# EAGLE schematic Resistor_Resistor (EAGLE 8.3.0), part 6 of 43 (continued)
## Parts (continued)
R8053  10K  RESISTOR_0201  [0201]
R8054  10K  RESISTOR_0201  [0201]
R8055  10K  RESISTOR_0201  [0201]
R8056  10K  RESISTOR_0201  [0201]
R8057  10K  RESISTOR_0201  [0201]
R8058  10K  RESISTOR_0201  [0201]
R8059  10K  RESISTOR_0201  [0201]
R8060  10K  RESISTOR_0201  [0201]
R8061  10K  RESISTOR_0201  [0201]
R8062  10K  RESISTOR_0201  [0201]
R8063  10K  RESISTOR_0201  [0201]
R8064  10K  RESISTOR_0201  [0201]
R8065  10K  RESISTOR_0201  [0201]
R8066  10K  RESISTOR_0201  [0201]
R8067  10K  RESISTOR_0201  [0201]
R8068  10K  RESISTOR_0201  [0201]
R8069  10K  RESISTOR_0201  [0201]
R8070  10K  RESISTOR_0201  [0201]
R8071  10K  RESISTOR_0201  [0201]
R8072  10K  RESISTOR_0201  [0201]
R8073  10K  RESISTOR_0201  [0201]
R8074  10K  RESISTOR_0201  [0201]
R8075  10K  RESISTOR_0201  [0201]
R8076  10K  RESISTOR_0201  [0201]
R8077  10K  RESISTOR_0201  [0201]
R8078  10K  RESISTOR_0201  [0201]
R8079  10K  RESISTOR_0201  [0201]
R8080  10K  RESISTOR_0201  [0201]
R8081  10K  RESISTOR_0201  [0201]
R8082  10K  RESISTOR_0201  [0201]
R8083  10K  RESISTOR_0201  [0201]
R8084  10K  RESISTOR_0201  [0201]
R8085  10K  RESISTOR_0201  [0201]
R8086  10K  RESISTOR_0201  [0201]
R8087  10K  RESISTOR_0201  [0201]
R8088  10K  RESISTOR_0201  [0201]
R8089  10K  RESISTOR_0201  [0201]
R8090  10K  RESISTOR_0201  [0201]
R8091  10K  RESISTOR_0201  [0201]
R8092  10K  RESISTOR_0201  [0201]
R8093  10K  RESISTOR_0201  [0201]
R8094  10K  RESISTOR_0201  [0201]
R8095  10K  RESISTOR_0201  [0201]
R8096  10K  RESISTOR_0201  [0201]
R8097  10K  RESISTOR_0201  [0201]
R8098  10K  RESISTOR_0201  [0201]
R8099  10K  RESISTOR_0201  [0201]
R8100  10K  RESISTOR_0201  [0201]
R8101  10K  RESISTOR_0201  [0201]
R8102  10K  RESISTOR_0201  [0201]
R8103  10K  RESISTOR_0201  [0201]
R8104  10K  RESISTOR_0201  [0201]
R8105  10K  RESISTOR_0201  [0201]
R8106  10K  RESISTOR_0201  [0201]
R8107  10K  RESISTOR_0201  [0201]
R8108  10K  RESISTOR_0201  [0201]
R8109  10K  RESISTOR_0201  [0201]
R8110  10K  RESISTOR_0201  [0201]
R8111  10K  RESISTOR_0201  [0201]
R8112  10K  RESISTOR_0201  [0201]
R8113  10K  RESISTOR_0201  [0201]
R8114  10K  RESISTOR_0201  [0201]
R8115  10K  RESISTOR_0201  [0201]
R8116  10K  RESISTOR_0201  [0201]
R8117  10K  RESISTOR_0201  [0201]
R8118  10K  RESISTOR_0201  [0201]
R8119  10K  RESISTOR_0201  [0201]
R8120  10K  RESISTOR_0201  [0201]
R8121  10K  RESISTOR_0201  [0201]
R8122  10K  RESISTOR_0201  [0201]
R8123  10K  RESISTOR_0201  [0201]
R8124  10K  RESISTOR_0201  [0201]
R8125  10K  RESISTOR_0201  [0201]
R8126  10K  RESISTOR_0201  [0201]
R8127  10K  RESISTOR_0201  [0201]
R8128  10K  RESISTOR_0201  [0201]
R8129  10K  RESISTOR_0201  [0201]
R8130  10K  RESISTOR_0201  [0201]
R8131  10K  RESISTOR_0201  [0201]
R8132  10K  RESISTOR_0201  [0201]
R8133  10K  RESISTOR_0201  [0201]
R8134  10K  RESISTOR_0201  [0201]
R8135  10K  RESISTOR_0201  [0201]
R8136  10K  RESISTOR_0201  [0201]
R8137  10K  RESISTOR_0201  [0201]
R8138  10K  RESISTOR_0201  [0201]
R8139  10K  RESISTOR_0201  [0201]
R8140  10K  RESISTOR_0201  [0201]
R8141  10K  RESISTOR_0201  [0201]
R8142  10K  RESISTOR_0201  [0201]
R8143  10K  RESISTOR_0201  [0201]
R8144  10K  RESISTOR_0201  [0201]
R8145  10K  RESISTOR_0201  [0201]
R8146  10K  RESISTOR_0201  [0201]
R8147  10K  RESISTOR_0201  [0201]
R8148  10K  RESISTOR_0201  [0201]
R8149  10K  RESISTOR_0201  [0201]
R8150  10K  RESISTOR_0201  [0201]
R8151  10K  RESISTOR_0201  [0201]
R8152  10K  RESISTOR_0201  [0201]
R8153  10K  RESISTOR_0201  [0201]
R8154  10K  RESISTOR_0201  [0201]
R8155  10K  RESISTOR_0201  [0201]
R8156  10K  RESISTOR_0201  [0201]
R8157  10K  RESISTOR_0201  [0201]
R8158  10K  RESISTOR_0201  [0201]
R8159  10K  RESISTOR_0201  [0201]
R8160  10K  RESISTOR_0201  [0201]
R8161  10K  RESISTOR_0201  [0201]
R8162  10K  RESISTOR_0201  [0201]
R8163  10K  RESISTOR_0201  [0201]
R8164  10K  RESISTOR_0201  [0201]
R8165  10K  RESISTOR_0201  [0201]
R8166  10K  RESISTOR_0201  [0201]
R8167  10K  RESISTOR_0201  [0201]
R8168  10K  RESISTOR_0201  [0201]
R8169  10K  RESISTOR_0201  [0201]
R8170  10K  RESISTOR_0201  [0201]
R8171  10K  RESISTOR_0201  [0201]
R8172  10K  RESISTOR_0201  [0201]
R8173  10K  RESISTOR_0201  [0201]
R8174  10K  RESISTOR_0201  [0201]
R8175  10K  RESISTOR_0201  [0201]
R8176  10K  RESISTOR_0201  [0201]
R8177  10K  RESISTOR_0201  [0201]
R8178  10K  RESISTOR_0201  [0201]
R8179  10K  RESISTOR_0201  [0201]
R8180  10K  RESISTOR_0201  [0201]
R8181  10K  RESISTOR_0201  [0201]
R8182  10K  RESISTOR_0201  [0201]
R8183  10K  RESISTOR_0201  [0201]
R8184  10K  RESISTOR_0201  [0201]
R8185  10K  RESISTOR_0201  [0201]
R8186  10K  RESISTOR_0201  [0201]
R8187  10K  RESISTOR_0201  [0201]
R8188  10K  RESISTOR_0201  [0201]
R8189  10K  RESISTOR_0201  [0201]
R8190  10K  RESISTOR_0201  [0201]
R8191  10K  RESISTOR_0201  [0201]
R8192  10K  RESISTOR_0201  [0201]
R8193  10K  RESISTOR_0201  [0201]
R8194  10K  RESISTOR_0201  [0201]
R8195  10K  RESISTOR_0201  [0201]
R8196  10K  RESISTOR_0201  [0201]
R8197  10K  RESISTOR_0201  [0201]
R8198  10K  RESISTOR_0201  [0201]
R8199  10K  RESISTOR_0201  [0201]
R8200  10K  RESISTOR_0201  [0201]
R8201  10K  RESISTOR_0201  [0201]
R8202  10K  RESISTOR_0201  [0201]
R8203  10K  RESISTOR_0201  [0201]
R8204  10K  RESISTOR_0201  [0201]
R8205  10K  RESISTOR_0201  [0201]
R8206  10K  RESISTOR_0201  [0201]
R8207  10K  RESISTOR_0201  [0201]
R8208  10K  RESISTOR_0201  [0201]
R8209  10K  RESISTOR_0201  [0201]
R8210  10K  RESISTOR_0201  [0201]
R8211  10K  RESISTOR_0201  [0201]
R8212  10K  RESISTOR_0201  [0201]
R8213  10K  RESISTOR_0201  [0201]
R8214  10K  RESISTOR_0201  [0201]
R8215  10K  RESISTOR_0201  [0201]
R8216  10K  RESISTOR_0201  [0201]
R8217  10K  RESISTOR_0201  [0201]
R8218  10K  RESISTOR_0201  [0201]
R8219  10K  RESISTOR_0201  [0201]
R8220  10K  RESISTOR_0201  [0201]
R8221  10K  RESISTOR_0201  [0201]
R8222  10K  RESISTOR_0201  [0201]
R8223  10K  RESISTOR_0201  [0201]
R8224  10K  RESISTOR_0201  [0201]
R8225  10K  RESISTOR_0201  [0201]
R8226  10K  RESISTOR_0201  [0201]
R8227  10K  RESISTOR_0201  [0201]
R8228  10K  RESISTOR_0201  [0201]
R8229  10K  RESISTOR_0201  [0201]
R8230  10K  RESISTOR_0201  [0201]
R8231  10K  RESISTOR_0201  [0201]
R8232  10K  RESISTOR_0201  [0201]
R8233  10K  RESISTOR_0201  [0201]
R8234  10K  RESISTOR_0201  [0201]
R8235  10K  RESISTOR_0201  [0201]
R8236  10K  RESISTOR_0201  [0201]
R8237  10K  RESISTOR_0201  [0201]
R8238  10K  RESISTOR_0201  [0201]
R8239  10K  RESISTOR_0201  [0201]
R8240  10K  RESISTOR_0201  [0201]
R8241  10K  RESISTOR_0201  [0201]
R8242  10K  RESISTOR_0201  [0201]
R8243  10K  RESISTOR_0201  [0201]
R8244  10K  RESISTOR_0201  [0201]
R8245  10K  RESISTOR_0201  [0201]
R8246  10K  RESISTOR_0201  [0201]
R8247  10K  RESISTOR_0201  [0201]
R8248  10K  RESISTOR_0201  [0201]
R8249  10K  RESISTOR_0201  [0201]
R8250  10K  RESISTOR_0201  [0201]
R8251  10K  RESISTOR_0201  [0201]
R8252  10K  RESISTOR_0201  [0201]
R8253  10K  RESISTOR_0201  [0201]
R8254  10K  RESISTOR_0201  [0201]
R8255  10K  RESISTOR_0201  [0201]
R8256  10K  RESISTOR_0201  [0201]
R8257  10K  RESISTOR_0201  [0201]
R8258  10K  RESISTOR_0201  [0201]
R8259  10K  RESISTOR_0201  [0201]
R8260  10K  RESISTOR_0201  [0201]
R8261  10K  RESISTOR_0201  [0201]
R8262  10K  RESISTOR_0201  [0201]
R8263  10K  RESISTOR_0201  [0201]
R8264  10K  RESISTOR_0201  [0201]
R8265  10K  RESISTOR_0201  [0201]
R8266  10K  RESISTOR_0201  [0201]
R8267  10K  RESISTOR_0201  [0201]
R8268  10K  RESISTOR_0201  [0201]
R8269  10K  RESISTOR_0201  [0201]
R8270  10K  RESISTOR_0201  [0201]
R8271  10K  RESISTOR_0201  [0201]
R8272  10K  RESISTOR_0201  [0201]
R8273  10K  RESISTOR_0201  [0201]
R8274  10K  RESISTOR_0201  [0201]
R8275  10K  RESISTOR_0201  [0201]
R8276  10K  RESISTOR_0201  [0201]
R8277  10K  RESISTOR_0201  [0201]
R8278  10K  RESISTOR_0201  [0201]
R8279  10K  RESISTOR_0201  [0201]
R8280  10K  RESISTOR_0201  [0201]
R8281  10K  RESISTOR_0201  [0201]
R8282  10K  RESISTOR_0201  [0201]
R8283  10K  RESISTOR_0201  [0201]
R8284  10K  RESISTOR_0201  [0201]
R8285  10K  RESISTOR_0201  [0201]
R8286  10K  RESISTOR_0201  [0201]
R8287  10K  RESISTOR_0201  [0201]
R8288  10K  RESISTOR_0201  [0201]
R8289  10K  RESISTOR_0201  [0201]
R8290  10K  RESISTOR_0201  [0201]
R8291  10K  RESISTOR_0201  [0201]
R8292  10K  RESISTOR_0201  [0201]
R8293  10K  RESISTOR_0201  [0201]
R8294  10K  RESISTOR_0201  [0201]
R8295  10K  RESISTOR_0201  [0201]
R8296  10K  RESISTOR_0201  [0201]
R8297  10K  RESISTOR_0201  [0201]
R8298  10K  RESISTOR_0201  [0201]
R8299  10K  RESISTOR_0201  [0201]
R8300  10K  RESISTOR_0201  [0201]
R8301  10K  RESISTOR_0201  [0201]
R8302  10K  RESISTOR_0201  [0201]
R8303  10K  RESISTOR_0201  [0201]
R8304  10K  RESISTOR_0201  [0201]
R8305  10K  RESISTOR_0201  [0201]
R8306  10K  RESISTOR_0201  [0201]
R8307  10K  RESISTOR_0201  [0201]
R8308  10K  RESISTOR_0201  [0201]
R8309  10K  RESISTOR_0201  [0201]
R8310  10K  RESISTOR_0201  [0201]
R8311  10K  RESISTOR_0201  [0201]
R8312  10K  RESISTOR_0201  [0201]
R8313  10K  RESISTOR_0201  [0201]
R8314  10K  RESISTOR_0201  [0201]
R8315  10K  RESISTOR_0201  [0201]
R8316  10K  RESISTOR_0201  [0201]
R8317  10K  RESISTOR_0201  [0201]
R8318  10K  RESISTOR_0201  [0201]
R8319  10K  RESISTOR_0201  [0201]
R8320  10K  RESISTOR_0201  [0201]
R8321  10K  RESISTOR_0201  [0201]
R8322  10K  RESISTOR_0201  [0201]
R8323  10K  RESISTOR_0201  [0201]
R8324  10K  RESISTOR_0201  [0201]
R8325  10K  RESISTOR_0201  [0201]
R8326  10K  RESISTOR_0201  [0201]
R8327  10K  RESISTOR_0201  [0201]
R8328  10K  RESISTOR_0201  [0201]
R8329  10K  RESISTOR_0201  [0201]
R8330  10K  RESISTOR_0201  [0201]
R8331  10K  RESISTOR_0201  [0201]
R8332  10K  RESISTOR_0201  [0201]
R8333  10K  RESISTOR_0201  [0201]
R8334  10K  RESISTOR_0201  [0201]
R8335  10K  RESISTOR_0201  [0201]
R8336  10K  RESISTOR_0201  [0201]
R8337  10K  RESISTOR_0201  [0201]
R8338  10K  RESISTOR_0201  [0201]
R8339  10K  RESISTOR_0201  [0201]
R8340  10K  RESISTOR_0201  [0201]
R8341  10K  RESISTOR_0201  [0201]
R8342  10K  RESISTOR_0201  [0201]
R8343  10K  RESISTOR_0201  [0201]
R8344  10K  RESISTOR_0201  [0201]
R8345  10K  RESISTOR_0201  [0201]
R8346  10K  RESISTOR_0201  [0201]
R8347  10K  RESISTOR_0201  [0201]
R8348  10K  RESISTOR_0201  [0201]
R8349  10K  RESISTOR_0201  [0201]
R8350  10K  RESISTOR_0201  [0201]
R8351  10K  RESISTOR_0201  [0201]
R8352  10K  RESISTOR_0201  [0201]
R8353  10K  RESISTOR_0201  [0201]
R8354  10K  RESISTOR_0201  [0201]
R8355  10K  RESISTOR_0201  [0201]
R8356  10K  RESISTOR_0201  [0201]
R8357  10K  RESISTOR_0201  [0201]
R8358  10K  RESISTOR_0201  [0201]
R8359  10K  RESISTOR_0201  [0201]
R8360  10K  RESISTOR_0201  [0201]
R8361  10K  RESISTOR_0201  [0201]
R8362  10K  RESISTOR_0201  [0201]
R8363  10K  RESISTOR_0201  [0201]
R8364  10K  RESISTOR_0201  [0201]
R8365  10K  RESISTOR_0201  [0201]
R8366  10K  RESISTOR_0201  [0201]
R8367  10K  RESISTOR_0201  [0201]
R8368  10K  RESISTOR_0201  [0201]
R8369  10K  RESISTOR_0201  [0201]
R8370  10K  RESISTOR_0201  [0201]
R8371  10K  RESISTOR_0201  [0201]
R8372  10K  RESISTOR_0201  [0201]
R8373  10K  RESISTOR_0201  [0201]
R8374  10K  RESISTOR_0201  [0201]
R8375  10K  RESISTOR_0201  [0201]
R8376  10K  RESISTOR_0201  [0201]
R8377  10K  RESISTOR_0201  [0201]
R8378  10K  RESISTOR_0201  [0201]
R8379  10K  RESISTOR_0201  [0201]
R8380  10K  RESISTOR_0201  [0201]
R8381  10K  RESISTOR_0201  [0201]
R8382  10K  RESISTOR_0201  [0201]
R8383  10K  RESISTOR_0201  [0201]
R8384  10K  RESISTOR_0201  [0201]
R8385  10K  RESISTOR_0201  [0201]
R8386  10K  RESISTOR_0201  [0201]
R8387  10K  RESISTOR_0201  [0201]
R8388  10K  RESISTOR_0201  [0201]
R8389  10K  RESISTOR_0201  [0201]
R8390  10K  RESISTOR_0201  [0201]
R8391  10K  RESISTOR_0201  [0201]
R8392  10K  RESISTOR_0201  [0201]
R8393  10K  RESISTOR_0201  [0201]
R8394  10K  RESISTOR_0201  [0201]
R8395  10K  RESISTOR_0201  [0201]
R8396  10K  RESISTOR_0201  [0201]
R8397  10K  RESISTOR_0201  [0201]
R8398  10K  RESISTOR_0201  [0201]
R8399  10K  RESISTOR_0201  [0201]
R8400  10K  RESISTOR_0201  [0201]
R8401  10K  RESISTOR_0201  [0201]
R8402  10K  RESISTOR_0201  [0201]
R8403  10K  RESISTOR_0201  [0201]
R8404  10K  RESISTOR_0201  [0201]
R8405  10K  RESISTOR_0201  [0201]
R8406  10K  RESISTOR_0201  [0201]
R8407  10K  RESISTOR_0201  [0201]
R8408  10K  RESISTOR_0201  [0201]
R8409  10K  RESISTOR_0201  [0201]
R8410  10K  RESISTOR_0201  [0201]
R8411  10K  RESISTOR_0201  [0201]
R8412  10K  RESISTOR_0201  [0201]
R8413  10K  RESISTOR_0201  [0201]
R8414  10K  RESISTOR_0201  [0201]
R8415  10K  RESISTOR_0201  [0201]
R8416  10K  RESISTOR_0201  [0201]
R8417  10K  RESISTOR_0201  [0201]
R8418  10K  RESISTOR_0201  [0201]
R8419  10K  RESISTOR_0201  [0201]
R8420  10K  RESISTOR_0201  [0201]
R8421  10K  RESISTOR_0201  [0201]
R8422  10K  RESISTOR_0201  [0201]
R8423  10K  RESISTOR_0201  [0201]
R8424  10K  RESISTOR_0201  [0201]
R8425  10K  RESISTOR_0201  [0201]
R8426  10K  RESISTOR_0201  [0201]
R8427  10K  RESISTOR_0201  [0201]
R8428  10K  RESISTOR_0201  [0201]
R8429  10K  RESISTOR_0201  [0201]
R8430  10K  RESISTOR_0201  [0201]
R8431  10K  RESISTOR_0201  [0201]
R8432  10K  RESISTOR_0201  [0201]
R8433  10K  RESISTOR_0201  [0201]
R8434  10K  RESISTOR_0201  [0201]
R8435  10K  RESISTOR_0201  [0201]
R8436  10K  RESISTOR_0201  [0201]
R8437  10K  RESISTOR_0201  [0201]
R8438  10K  RESISTOR_0201  [0201]
R8439  10K  RESISTOR_0201  [0201]
R8440  10K  RESISTOR_0201  [0201]
R8441  10K  RESISTOR_0201  [0201]
R8442  10K  RESISTOR_0201  [0201]
R8443  10K  RESISTOR_0201  [0201]
R8444  10K  RESISTOR_0201  [0201]
R8445  10K  RESISTOR_0201  [0201]
R8446  10K  RESISTOR_0201  [0201]
R8447  10K  RESISTOR_0201  [0201]
R8448  10K  RESISTOR_0201  [0201]
R8449  10K  RESISTOR_0201  [0201]
R8450  10K  RESISTOR_0201  [0201]
R8451  10K  RESISTOR_0201  [0201]
R8452  10K  RESISTOR_0201  [0201]
R8453  10K  RESISTOR_0201  [0201]
R8454  10K  RESISTOR_0201  [0201]
R8455  10K  RESISTOR_0201  [0201]
R8456  10K  RESISTOR_0201  [0201]
R8457  10K  RESISTOR_0201  [0201]
R8458  10K  RESISTOR_0201  [0201]
R8459  10K  RESISTOR_0201  [0201]
R8460  10K  RESISTOR_0201  [0201]
R8461  10K  RESISTOR_0201  [0201]
R8462  10K  RESISTOR_0201  [0201]
R8463  10K  RESISTOR_0201  [0201]
R8464  10K  RESISTOR_0201  [0201]
R8465  10K  RESISTOR_0201  [0201]
R8466  10K  RESISTOR_0201  [0201]
R8467  10K  RESISTOR_0201  [0201]
R8468  10K  RESISTOR_0201  [0201]
R8469  10K  RESISTOR_0201  [0201]
R8470  10K  RESISTOR_0201  [0201]
R8471  10K  RESISTOR_0201  [0201]
R8472  10K  RESISTOR_0201  [0201]
R8473  10K  RESISTOR_0201  [0201]
R8474  10K  RESISTOR_0201  [0201]
R8475  10K  RESISTOR_0201  [0201]
R8476  10K  RESISTOR_0201  [0201]
R8477  10K  RESISTOR_0201  [0201]
R8478  10K  RESISTOR_0201  [0201]
R8479  10K  RESISTOR_0201  [0201]
R8480  10K  RESISTOR_0201  [0201]
R8481  10K  RESISTOR_0201  [0201]
R8482  10K  RESISTOR_0201  [0201]
R8483  10K  RESISTOR_0201  [0201]
R8484  10K  RESISTOR_0201  [0201]
R8485  10K  RESISTOR_0201  [0201]
R8486  10K  RESISTOR_0201  [0201]
R8487  10K  RESISTOR_0201  [0201]
R8488  10K  RESISTOR_0201  [0201]
R8489  10K  RESISTOR_0201  [0201]
R8490  10K  RESISTOR_0201  [0201]
R8491  10K  RESISTOR_0201  [0201]
R8492  10K  RESISTOR_0201  [0201]
R8493  10K  RESISTOR_0201  [0201]
R8494  10K  RESISTOR_0201  [0201]
R8495  10K  RESISTOR_0201  [0201]
R8496  10K  RESISTOR_0201  [0201]
R8497  10K  RESISTOR_0201  [0201]
R8498  10K  RESISTOR_0201  [0201]
R8499  10K  RESISTOR_0201  [0201]
R8500  10K  RESISTOR_0201  [0201]
R8501  10K  RESISTOR_0201  [0201]
R8502  10K  RESISTOR_0201  [0201]
R8503  10K  RESISTOR_0201  [0201]
R8504  10K  RESISTOR_0201  [0201]
R8505  10K  RESISTOR_0201  [0201]
R8506  10K  RESISTOR_0201  [0201]
R8507  10K  RESISTOR_0201  [0201]
R8508  10K  RESISTOR_0201  [0201]
R8509  10K  RESISTOR_0201  [0201]
R8510  10K  RESISTOR_0201  [0201]
R8511  10K  RESISTOR_0201  [0201]
R8512  10K  RESISTOR_0201  [0201]
R8513  10K  RESISTOR_0201  [0201]
R8514  10K  RESISTOR_0201  [0201]
R8515  10K  RESISTOR_0201  [0201]
R8516  10K  RESISTOR_0201  [0201]
R8517  10K  RESISTOR_0201  [0201]
R8518  10K  RESISTOR_0201  [0201]
R8519  10K  RESISTOR_0201  [0201]
R8520  10K  RESISTOR_0201  [0201]
R8521  10K  RESISTOR_0201  [0201]
R8522  10K  RESISTOR_0201  [0201]
R8523  10K  RESISTOR_0201  [0201]
R8524  10K  RESISTOR_0201  [0201]
R8525  10K  RESISTOR_0201  [0201]
R8526  10K  RESISTOR_0201  [0201]
R8527  10K  RESISTOR_0201  [0201]
R8528  10K  RESISTOR_0201  [0201]
R8529  10K  RESISTOR_0201  [0201]
R8530  10K  RESISTOR_0201  [0201]
R8531  10K  RESISTOR_0201  [0201]
R8532  10K  RESISTOR_0201  [0201]
R8533  10K  RESISTOR_0201  [0201]
R8534  10K  RESISTOR_0201  [0201]
R8535  10K  RESISTOR_0201  [0201]
R8536  10K  RESISTOR_0201  [0201]
R8537  10K  RESISTOR_0201  [0201]
R8538  10K  RESISTOR_0201  [0201]
R8539  10K  RESISTOR_0201  [0201]
R8540  10K  RESISTOR_0201  [0201]
R8541  10K  RESISTOR_0201  [0201]
R8542  10K  RESISTOR_0201  [0201]
R8543  10K  RESISTOR_0201  [0201]
R8544  10K  RESISTOR_0201  [0201]
R8545  10K  RESISTOR_0201  [0201]
R8546  10K  RESISTOR_0201  [0201]
R8547  10K  RESISTOR_0201  [0201]
R8548  10K  RESISTOR_0201  [0201]
R8549  10K  RESISTOR_0201  [0201]
R8550  10K  RESISTOR_0201  [0201]
R8551  10K  RESISTOR_0201  [0201]
R8552  10K  RESISTOR_0201  [0201]
R8553  10K  RESISTOR_0201  [0201]
R8554  10K  RESISTOR_0201  [0201]
R8555  10K  RESISTOR_0201  [0201]
R8556  10K  RESISTOR_0201  [0201]
R8557  10K  RESISTOR_0201  [0201]
R8558  10K  RESISTOR_0201  [0201]
R8559  10K  RESISTOR_0201  [0201]
R8560  10K  RESISTOR_0201  [0201]
R8561  10K  RESISTOR_0201  [0201]
R8562  10K  RESISTOR_0201  [0201]
R8563  10K  RESISTOR_0201  [0201]
R8564  10K  RESISTOR_0201  [0201]
R8565  10K  RESISTOR_0201  [0201]
R8566  10K  RESISTOR_0201  [0201]
R8567  10K  RESISTOR_0201  [0201]
R8568  10K  RESISTOR_0201  [0201]
R8569  10K  RESISTOR_0201  [0201]
R8570  10K  RESISTOR_0201  [0201]
R8571  10K  RESISTOR_0201  [0201]
R8572  10K  RESISTOR_0201  [0201]
R8573  10K  RESISTOR_0201  [0201]
R8574  10K  RESISTOR_0201  [0201]
R8575  10K  RESISTOR_0201  [0201]
R8576  10K  RESISTOR_0201  [0201]
R8577  10K  RESISTOR_0201  [0201]
R8578  10K  RESISTOR_0201  [0201]
R8579  10K  RESISTOR_0201  [0201]
R8580  10K  RESISTOR_0201  [0201]
R8581  10K  RESISTOR_0201  [0201]
R8582  10K  RESISTOR_0201  [0201]
R8583  10K  RESISTOR_0201  [0201]
R8584  10K  RESISTOR_0201  [0201]
R8585  10K  RESISTOR_0201  [0201]
R8586  10K  RESISTOR_0201  [0201]
R8587  10K  RESISTOR_0201  [0201]
R8588  10K  RESISTOR_0201  [0201]
R8589  10K  RESISTOR_0201  [0201]
R8590  10K  RESISTOR_0201  [0201]
R8591  10K  RESISTOR_0201  [0201]
R8592  10K  RESISTOR_0201  [0201]
R8593  10K  RESISTOR_0201  [0201]
R8594  10K  RESISTOR_0201  [0201]
R8595  10K  RESISTOR_0201  [0201]
R8596  10K  RESISTOR_0201  [0201]
R8597  10K  RESISTOR_0201  [0201]
R8598  10K  RESISTOR_0201  [0201]
R8599  10K  RESISTOR_0201  [0201]
R8600  10K  RESISTOR_0201  [0201]
R8601  10K  RESISTOR_0201  [0201]
R8602  10K  RESISTOR_0201  [0201]
R8603  10K  RESISTOR_0201  [0201]
R8604  10K  RESISTOR_0201  [0201]
R8605  10K  RESISTOR_0201  [0201]
R8606  10K  RESISTOR_0201  [0201]
R8607  10K  RESISTOR_0201  [0201]
R8608  10K  RESISTOR_0201  [0201]
R8609  10K  RESISTOR_0201  [0201]
R8610  10K  RESISTOR_0201  [0201]
R8611  10K  RESISTOR_0201  [0201]
R8612  10K  RESISTOR_0201  [0201]
R8613  10K  RESISTOR_0201  [0201]
R8614  10K  RESISTOR_0201  [0201]
R8615  10K  RESISTOR_0201  [0201]
R8616  10K  RESISTOR_0201  [0201]
R8617  10K  RESISTOR_0201  [0201]
R8618  10K  RESISTOR_0201  [0201]
R8619  10K  RESISTOR_0201  [0201]
R8620  10K  RESISTOR_0201  [0201]
R8621  10K  RESISTOR_0201  [0201]
R8622  10K  RESISTOR_0201  [0201]
R8623  10K  RESISTOR_0201  [0201]
R8624  10K  RESISTOR_0201  [0201]
R8625  10K  RESISTOR_0201  [0201]
R8626  10K  RESISTOR_0201  [0201]
R8627  10K  RESISTOR_0201  [0201]
R8628  10K  RESISTOR_0201  [0201]
R8629  10K  RESISTOR_0201  [0201]
R8630  10K  RESISTOR_0201  [0201]
R8631  10K  RESISTOR_0201  [0201]
R8632  10K  RESISTOR_0201  [0201]
R8633  10K  RESISTOR_0201  [0201]
R8634  10K  RESISTOR_0201  [0201]
R8635  10K  RESISTOR_0201  [0201]
R8636  10K  RESISTOR_0201  [0201]
R8637  10K  RESISTOR_0201  [0201]
R8638  10K  RESISTOR_0201  [0201]
R8639  10K  RESISTOR_0201  [0201]
R8640  10K  RESISTOR_0201  [0201]
R8641  10K  RESISTOR_0201  [0201]
R8642  10K  RESISTOR_0201  [0201]
R8643  10K  RESISTOR_0201  [0201]
R8644  10K  RESISTOR_0201  [0201]
R8645  10K  RESISTOR_0201  [0201]
R8646  10K  RESISTOR_0201  [0201]
R8647  10K  RESISTOR_0201  [0201]
R8648  10K  RESISTOR_0201  [0201]
R8649  10K  RESISTOR_0201  [0201]
R8650  10K  RESISTOR_0201  [0201]
R8651  10K  RESISTOR_0201  [0201]
R8652  10K  RESISTOR_0201  [0201]
R8653  10K  RESISTOR_0201  [0201]
R8654  10K  RESISTOR_0201  [0201]
R8655  10K  RESISTOR_0201  [0201]
R8656  10K  RESISTOR_0201  [0201]
R8657  10K  RESISTOR_0201  [0201]
R8658  10K  RESISTOR_0201  [0201]
R8659  10K  RESISTOR_0201  [0201]
R8660  10K  RESISTOR_0201  [0201]
R8661  10K  RESISTOR_0201  [0201]
R8662  10K  RESISTOR_0201  [0201]
R8663  10K  RESISTOR_0201  [0201]
R8664  10K  RESISTOR_0201  [0201]
R8665  10K  RESISTOR_0201  [0201]
R8666  10K  RESISTOR_0201  [0201]
R8667  10K  RESISTOR_0201  [0201]
R8668  10K  RESISTOR_0201  [0201]
R8669  10K  RESISTOR_0201  [0201]
R8670  10K  RESISTOR_0201  [0201]
R8671  10K  RESISTOR_0201  [0201]
R8672  10K  RESISTOR_0201  [0201]
R8673  10K  RESISTOR_0201  [0201]
R8674  10K  RESISTOR_0201  [0201]
R8675  10K  RESISTOR_0201  [0201]
R8676  10K  RESISTOR_0201  [0201]
R8677  10K  RESISTOR_0201  [0201]
R8678  10K  RESISTOR_0201  [0201]
R8679  10K  RESISTOR_0201  [0201]
R8680  10K  RESISTOR_0201  [0201]
R8681  10K  RESISTOR_0201  [0201]
R8682  10K  RESISTOR_0201  [0201]
R8683  10K  RESISTOR_0201  [0201]
R8684  10K  RESISTOR_0201  [0201]
R8685  10K  RESISTOR_0201  [0201]
R8686  10K  RESISTOR_0201  [0201]
R8687  10K  RESISTOR_0201  [0201]
R8688  10K  RESISTOR_0201  [0201]
R8689  10K  RESISTOR_0201  [0201]
R8690  10K  RESISTOR_0201  [0201]
R8691  10K  RESISTOR_0201  [0201]
R8692  10K  RESISTOR_0201  [0201]
R8693  10K  RESISTOR_0201  [0201]
R8694  10K  RESISTOR_0201  [0201]
R8695  10K  RESISTOR_0201  [0201]
R8696  10K  RESISTOR_0201  [0201]
R8697  10K  RESISTOR_0201  [0201]
R8698  10K  RESISTOR_0201  [0201]
R8699  10K  RESISTOR_0201  [0201]
R8700  10K  RESISTOR_0201  [0201]
R8701  10K  RESISTOR_0201  [0201]
R8702  10K  RESISTOR_0201  [0201]
R8703  10K  RESISTOR_0201  [0201]
R8704  10K  RESISTOR_0201  [0201]
R8705  10K  RESISTOR_0201  [0201]
R8706  10K  RESISTOR_0201  [0201]
R8707  10K  RESISTOR_0201  [0201]
R8708  10K  RESISTOR_0201  [0201]
R8709  10K  RESISTOR_0201  [0201]
R8710  10K  RESISTOR_0201  [0201]
R8711  10K  RESISTOR_0201  [0201]
R8712  10K  RESISTOR_0201  [0201]
R8713  10K  RESISTOR_0201  [0201]
R8714  10K  RESISTOR_0201  [0201]
R8715  10K  RESISTOR_0201  [0201]
R8716  10K  RESISTOR_0201  [0201]
R8717  10K  RESISTOR_0201  [0201]
R8718  10K  RESISTOR_0201  [0201]
R8719  10K  RESISTOR_0201  [0201]
R8720  10K  RESISTOR_0201  [0201]
R8721  10K  RESISTOR_0201  [0201]
R8722  10K  RESISTOR_0201  [0201]
R8723  10K  RESISTOR_0201  [0201]
R8724  10K  RESISTOR_0201  [0201]
R8725  10K  RESISTOR_0201  [0201]
R8726  10K  RESISTOR_0201  [0201]
R8727  10K  RESISTOR_0201  [0201]
R8728  10K  RESISTOR_0201  [0201]
R8729  10K  RESISTOR_0201  [0201]
R8730  10K  RESISTOR_0201  [0201]
R8731  10K  RESISTOR_0201  [0201]
R8732  10K  RESISTOR_0201  [0201]
R8733  10K  RESISTOR_0201  [0201]
R8734  10K  RESISTOR_0201  [0201]
R8735  10K  RESISTOR_0201  [0201]
R8736  10K  RESISTOR_0201  [0201]
R8737  10K  RESISTOR_0201  [0201]
R8738  10K  RESISTOR_0201  [0201]
R8739  10K  RESISTOR_0201  [0201]
R8740  10K  RESISTOR_0201  [0201]
R8741  10K  RESISTOR_0201  [0201]
R8742  10K  RESISTOR_0201  [0201]
R8743  10K  RESISTOR_0201  [0201]
R8744  10K  RESISTOR_0201  [0201]
R8745  10K  RESISTOR_0201  [0201]
R8746  10K  RESISTOR_0201  [0201]
R8747  10K  RESISTOR_0201  [0201]
R8748  10K  RESISTOR_0201  [0201]
R8749  10K  RESISTOR_0201  [0201]
R8750  10K  RESISTOR_0201  [0201]
R8751  10K  RESISTOR_0201  [0201]
R8752  10K  RESISTOR_0201  [0201]
R8753  10K  RESISTOR_0201  [0201]
R8754  10K  RESISTOR_0201  [0201]
R8755  10K  RESISTOR_0201  [0201]
R8756  10K  RESISTOR_0201  [0201]
R8757  10K  RESISTOR_0201  [0201]
R8758  10K  RESISTOR_0201  [0201]
R8759  10K  RESISTOR_0201  [0201]
R8760  10K  RESISTOR_0201  [0201]
R8761  10K  RESISTOR_0201  [0201]
R8762  10K  RESISTOR_0201  [0201]
R8763  10K  RESISTOR_0201  [0201]
R8764  10K  RESISTOR_0201  [0201]
R8765  10K  RESISTOR_0201  [0201]
R8766  10K  RESISTOR_0201  [0201]
R8767  10K  RESISTOR_0201  [0201]
R8768  10K  RESISTOR_0201  [0201]
R8769  10K  RESISTOR_0201  [0201]
R8770  10K  RESISTOR_0201  [0201]
R8771  10K  RESISTOR_0201  [0201]
R8772  10K  RESISTOR_0201  [0201]
R8773  10K  RESISTOR_0201  [0201]
R8774  10K  RESISTOR_0201  [0201]
R8775  10K  RESISTOR_0201  [0201]
R8776  10K  RESISTOR_0201  [0201]
R8777  10K  RESISTOR_0201  [0201]
R8778  10K  RESISTOR_0201  [0201]
R8779  10K  RESISTOR_0201  [0201]
R8780  10K  RESISTOR_0201  [0201]
R8781  10K  RESISTOR_0201  [0201]
R8782  10K  RESISTOR_0201  [0201]
R8783  10K  RESISTOR_0201  [0201]